# Altium schematic sheet 0223_GPU POWER_ OTHER.SchDoc
size 848 x 558 mm
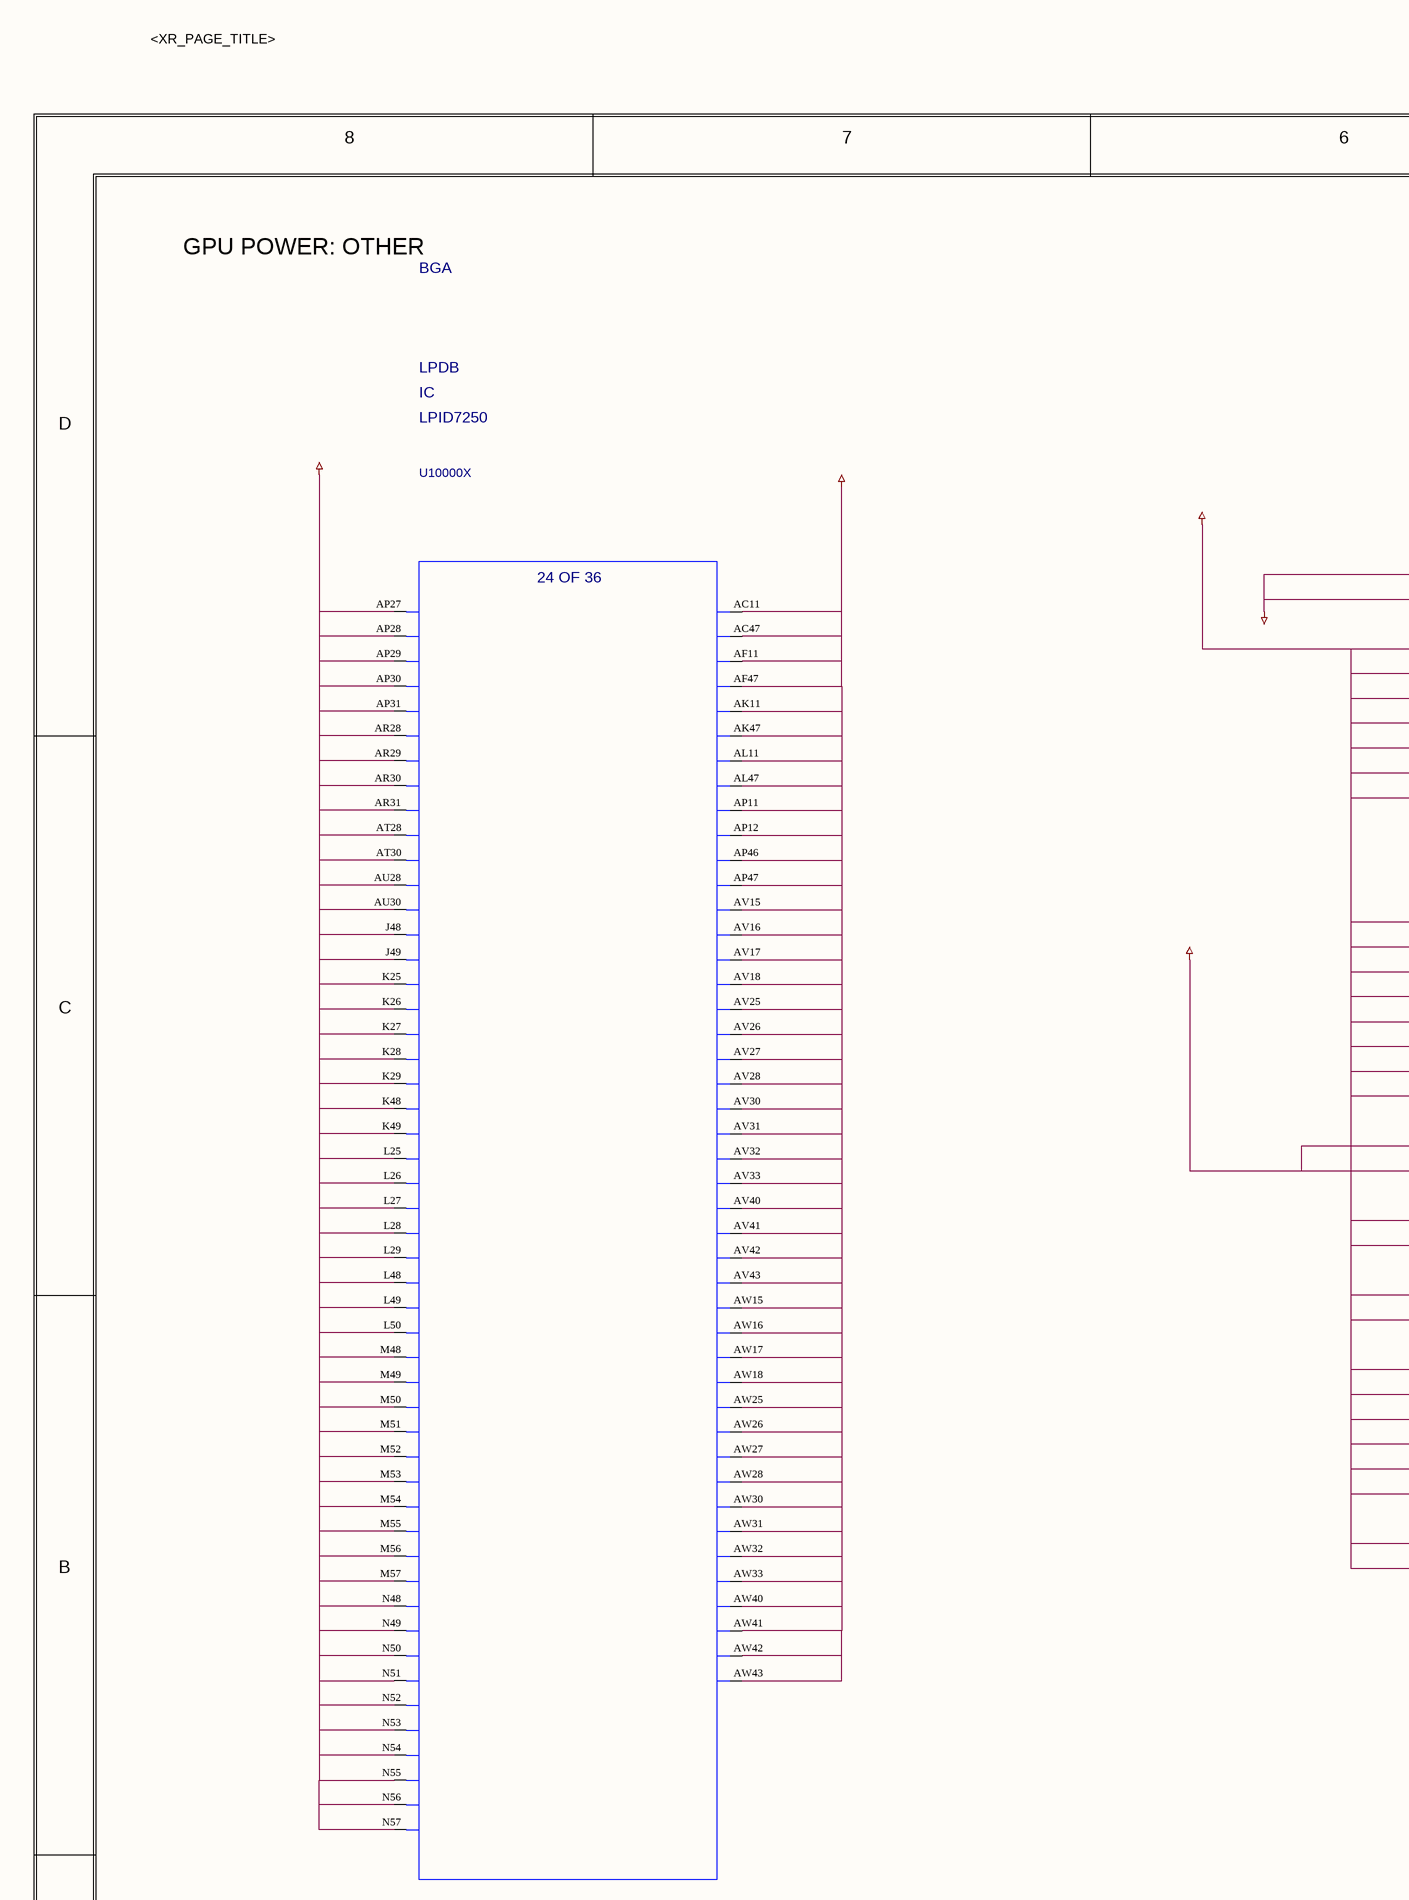
[diagram p0: 0223_GPU POWER_ OTHER.SchDoc, top left]
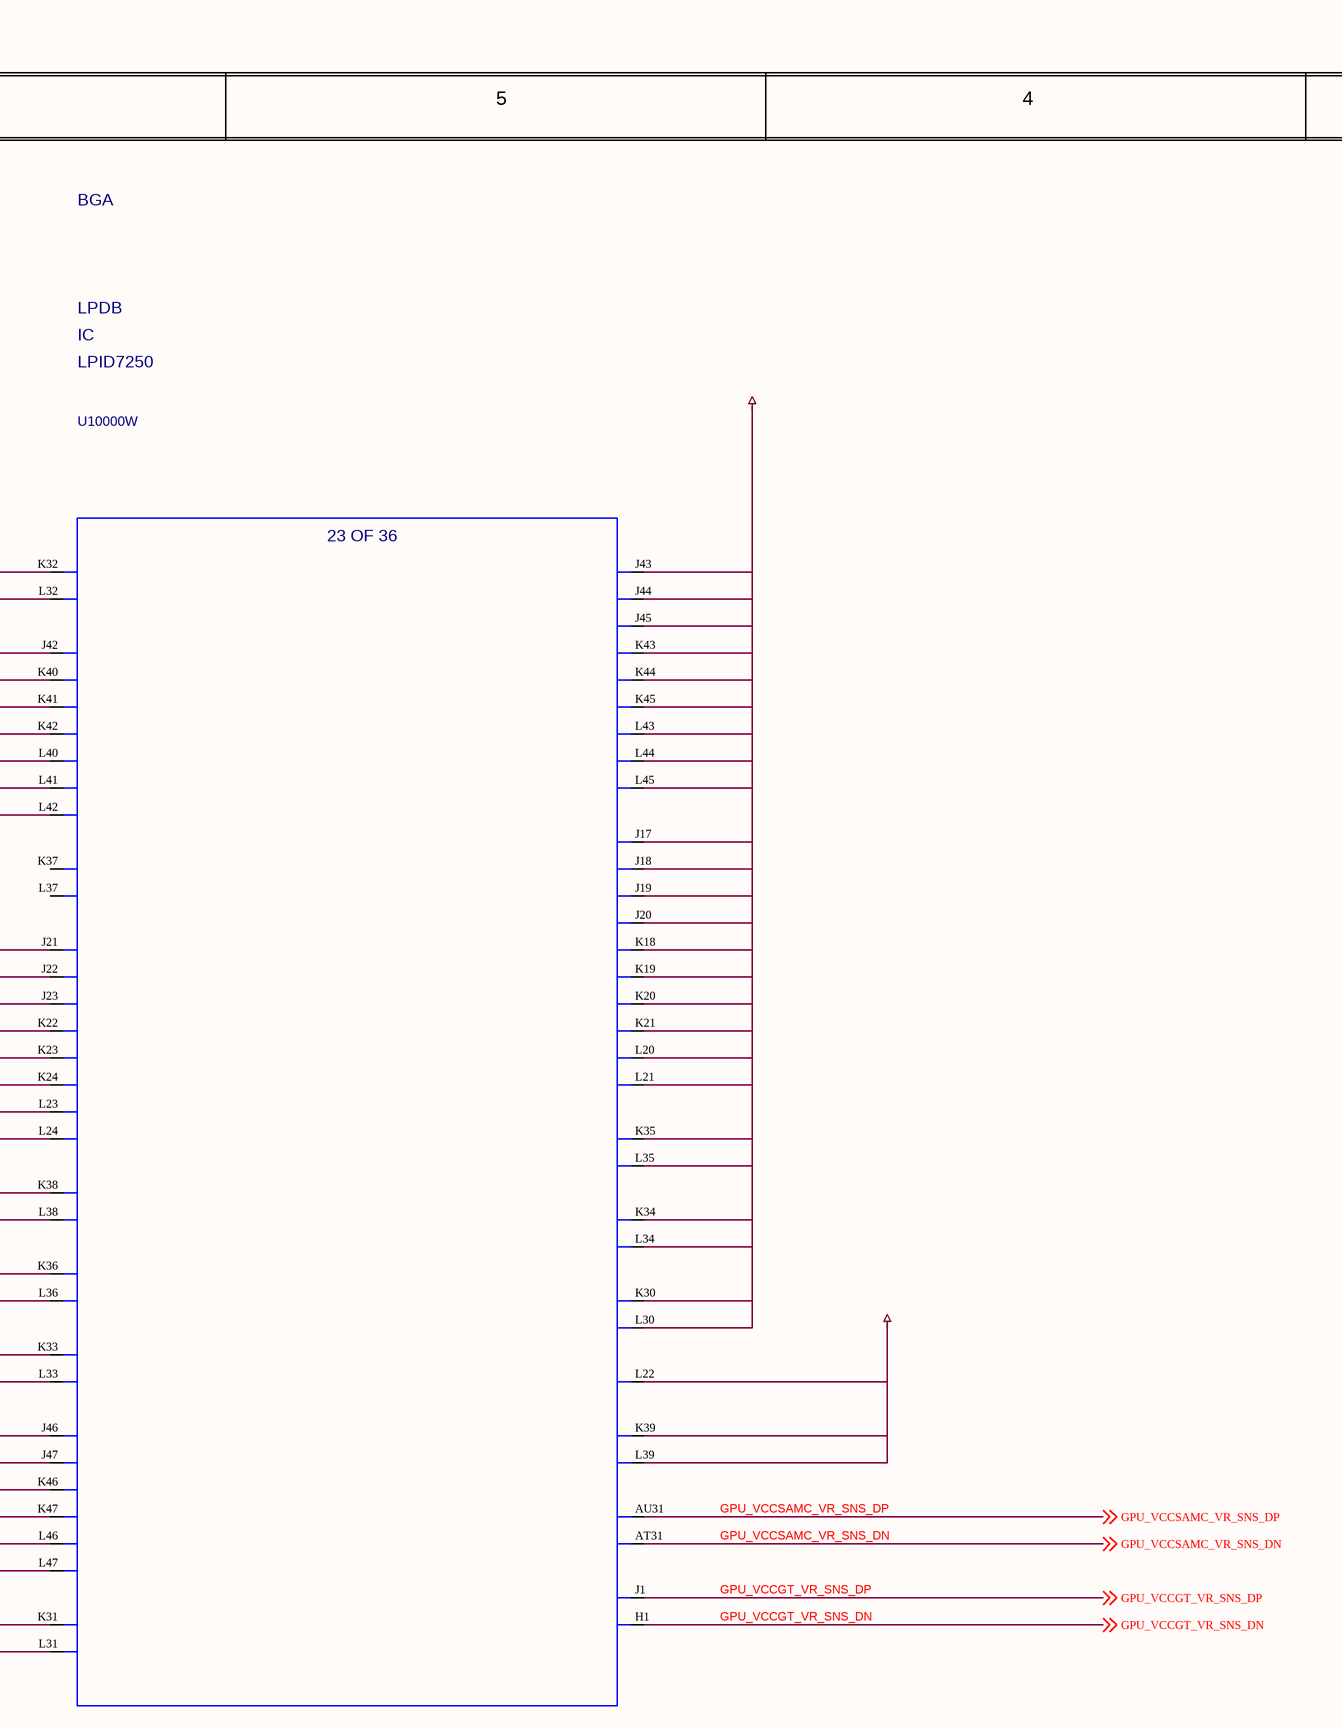
[diagram p1: 0223_GPU POWER_ OTHER.SchDoc, top middle]
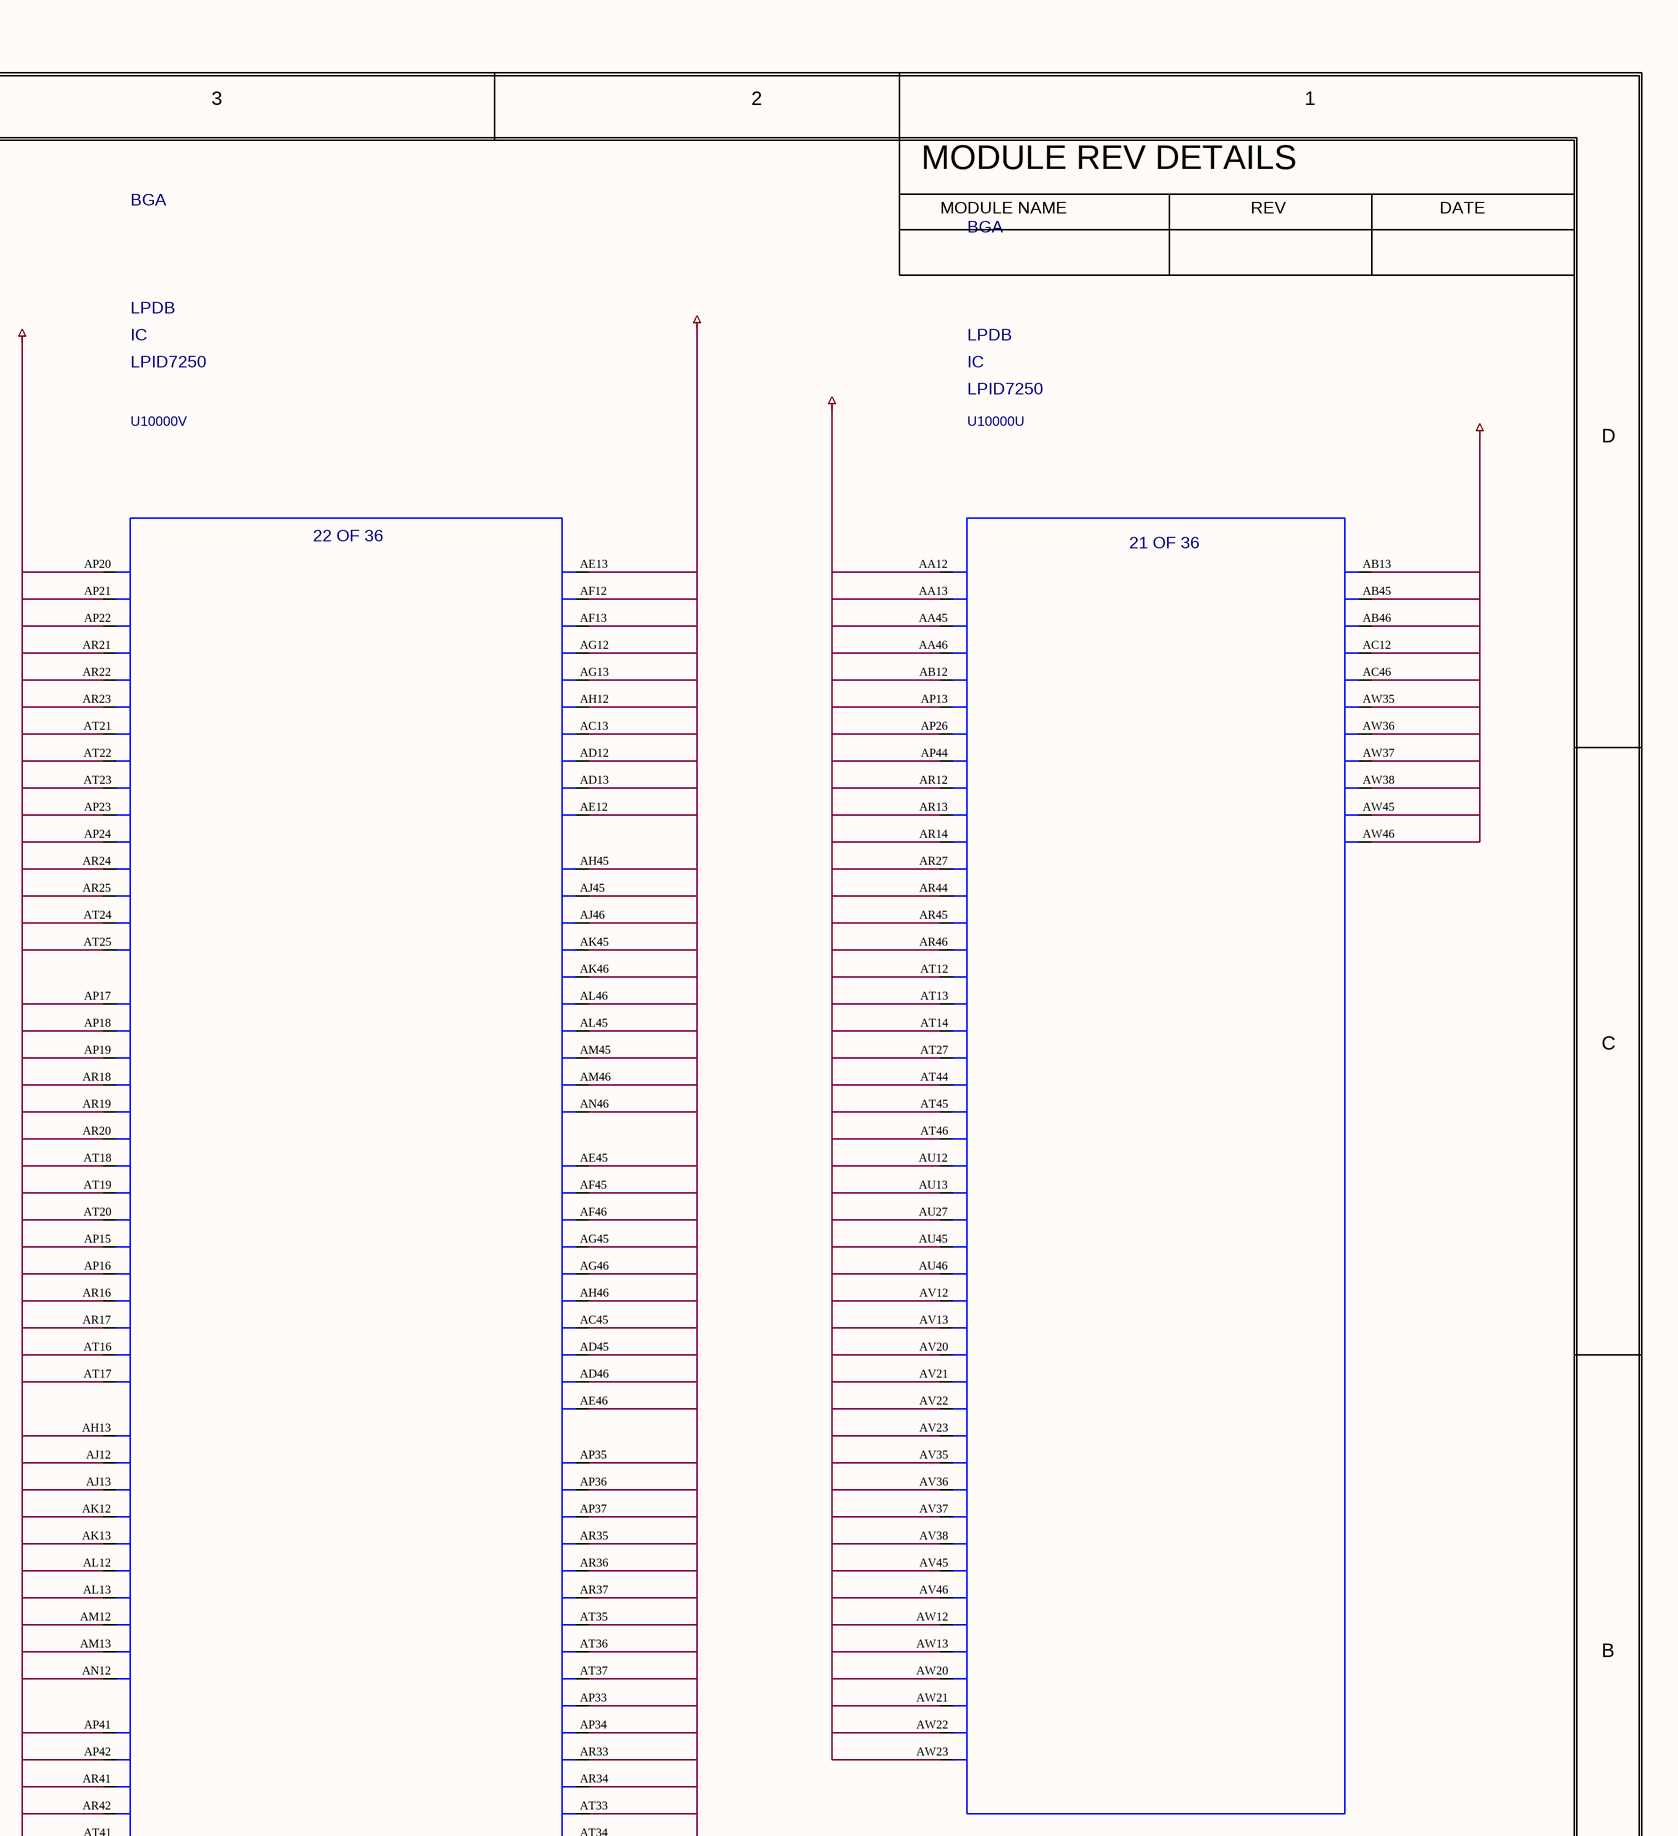
[diagram p2: 0223_GPU POWER_ OTHER.SchDoc, top right]
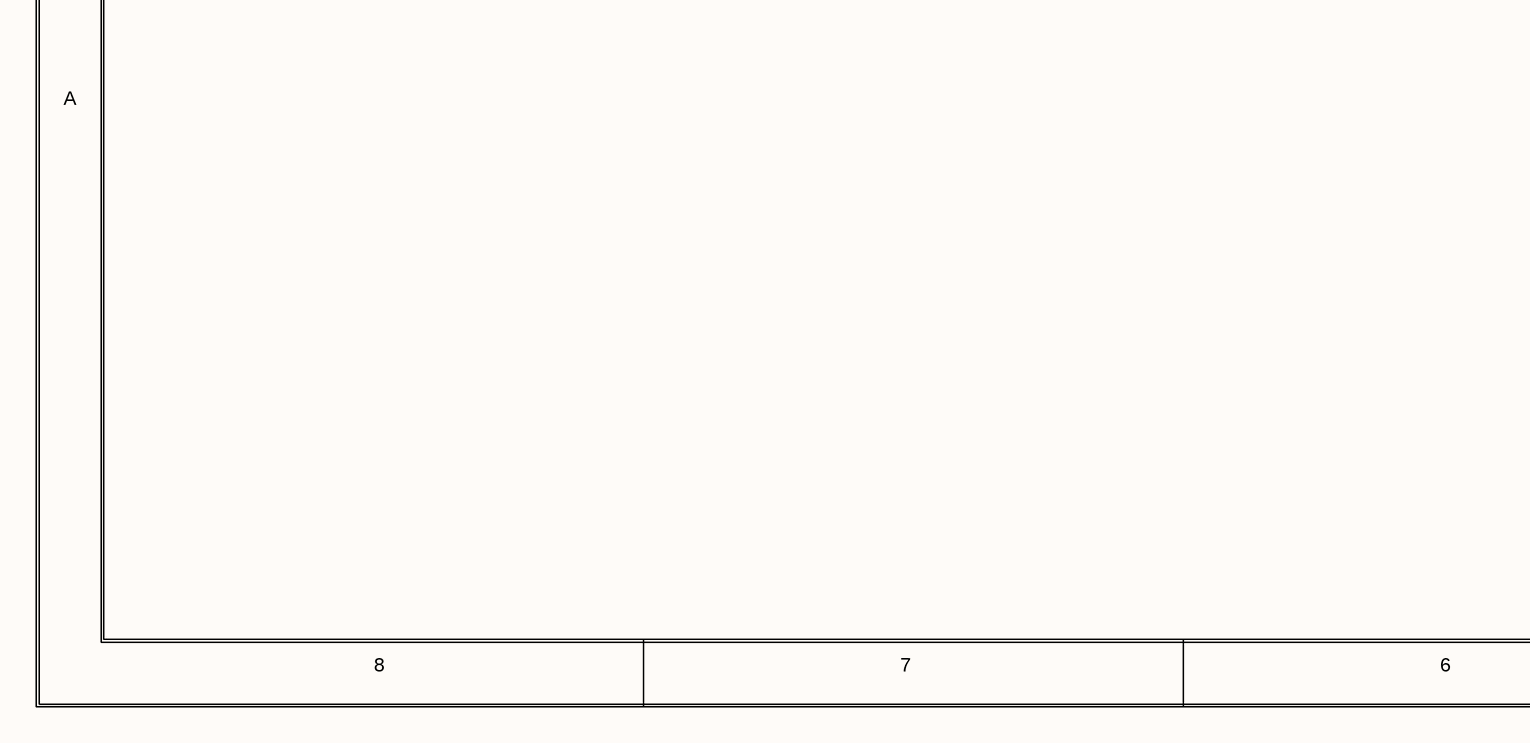
[diagram p3: 0223_GPU POWER_ OTHER.SchDoc, bottom left]
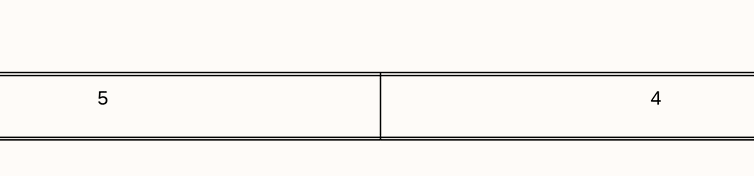
[diagram p4: 0223_GPU POWER_ OTHER.SchDoc, bottom middle]
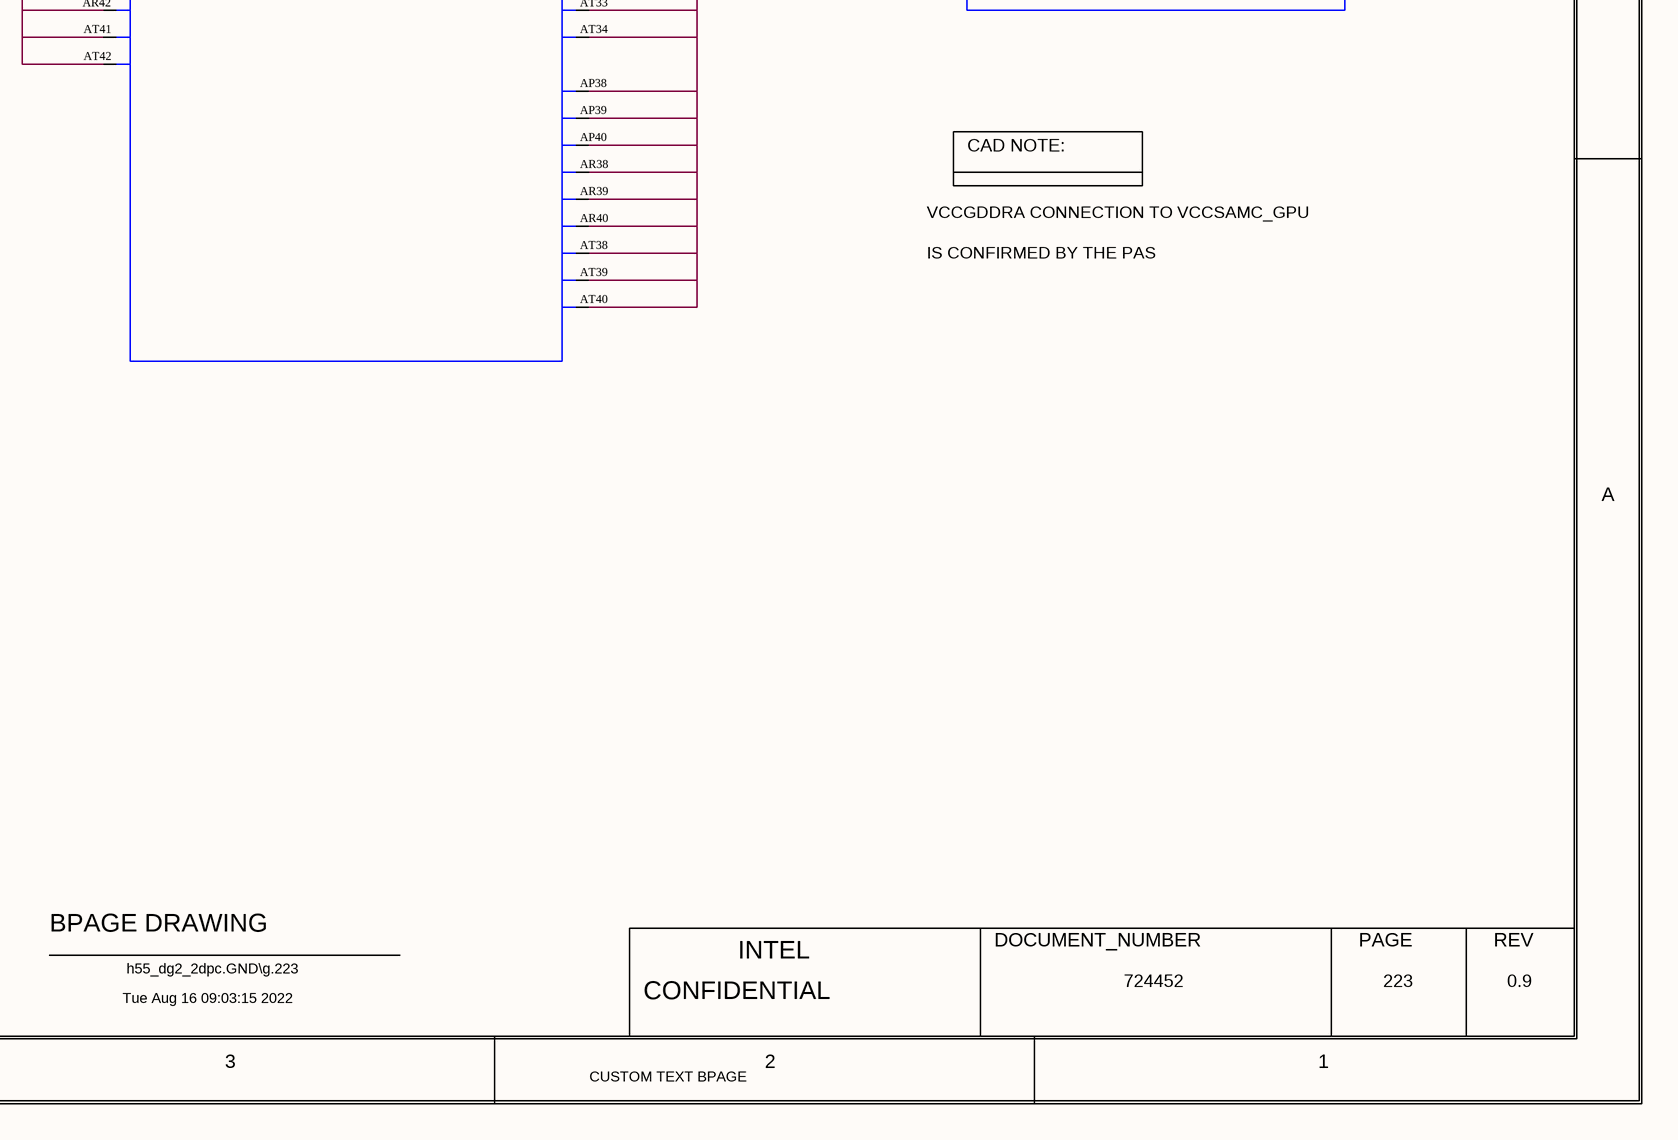
[diagram p5: 0223_GPU POWER_ OTHER.SchDoc, bottom right]

## Parts
U10000  PART_NUMBER: LPID7250  PACK_TYPE: BGA  MATERIAL: IC  FP_TECH: LPDB  [CLPDB_BGA2660_DG2_SVC_512_LP7250_MA]  (hidden comment: DG2_IP_NB_SKU1_SKU2_SKU3_EXT)  (parts U,V,W,X of 36)

## Nets
+V1P8_PLLVPH: U10000.K38(VCCPLLVPH_1) U10000.L38(VCCPLLVPH_2)
+V1P8S_GPU: U10000.J21(VCC1P8_14) U10000.J22(VCC1P8_15) U10000.J23(VCC1P8_16) U10000.J42(VCC1P8_1) U10000.J46(VCC1P8_8) U10000.J47(VCC1P8_9) U10000.K22(VCC1P8_17) U10000.K23(VCC1P8_18) U10000.K24(VCC1P8_19) U10000.K31(VCC1P8_27) U10000.K33(VCC1P8_29) U10000.K36(VCC1P8_22) U10000.K39(VCC1P8_25) U10000.K40(VCC1P8_2) U10000.K41(VCC1P8_3) U10000.K42(VCC1P8_4) U10000.K46(VCC1P8_10) U10000.K47(VCC1P8_11) U10000.L22(VCC1P8_24) U10000.L23(VCC1P8_20) U10000.L24(VCC1P8_21) U10000.L31(VCC1P8_28) U10000.L33(VCC1P8_30) U10000.L36(VCC1P8_23) U10000.L39(VCC1P8_26) U10000.L40(VCC1P8_5) U10000.L41(VCC1P8_6) U10000.L42(VCC1P8_7) U10000.L46(VCC1P8_12) U10000.L47(VCC1P8_13)
+VCCSA_GPU: U10000.AP27(VCCSA_1) U10000.AP28(VCCSA_2) U10000.AP29(VCCSA_3) U10000.AP30(VCCSA_4) U10000.AP31(VCCSA_5) U10000.AR28(VCCSA_6) U10000.AR29(VCCSA_7) U10000.AR30(VCCSA_8) U10000.AR31(VCCSA_9) U10000.AT28(VCCSA_10) U10000.AT30(VCCSA_11) U10000.AU28(VCCSA_12) U10000.AU30(VCCSA_13) U10000.J17(VCCSA_61) U10000.J18(VCCSA_62) U10000.J19(VCCSA_63) U10000.J20(VCCSA_64) U10000.J43(VCCSA_52) U10000.J44(VCCSA_53) U10000.J45(VCCSA_54) U10000.J48(VCCSA_14) U10000.J49(VCCSA_15) U10000.K18(VCCSA_65) U10000.K19(VCCSA_66) U10000.K20(VCCSA_67) U10000.K21(VCCSA_68) U10000.K25(VCCSA_16) U10000.K26(VCCSA_17) U10000.K27(VCCSA_18) U10000.K28(VCCSA_19) U10000.K29(VCCSA_20) U10000.K30(VCCSA_73) U10000.K34(VCCSA_75) U10000.K35(VCCSA_71) U10000.K43(VCCSA_55) U10000.K44(VCCSA_56) U10000.K45(VCCSA_57) U10000.K48(VCCSA_21) U10000.K49(VCCSA_22) U10000.L20(VCCSA_69) U10000.L21(VCCSA_70) U10000.L25(VCCSA_23) U10000.L26(VCCSA_24) U10000.L27(VCCSA_25) U10000.L28(VCCSA_26) U10000.L29(VCCSA_27) U10000.L30(VCCSA_74) U10000.L34(VCCSA_76) U10000.L35(VCCSA_72) U10000.L43(VCCSA_58) U10000.L44(VCCSA_59) U10000.L45(VCCSA_60) U10000.L48(VCCSA_28) U10000.L49(VCCSA_29) U10000.L50(VCCSA_30) U10000.M48(VCCSA_31) U10000.M49(VCCSA_32) U10000.M50(VCCSA_33) U10000.M51(VCCSA_34) U10000.M52(VCCSA_35) U10000.M53(VCCSA_36) U10000.M54(VCCSA_37) U10000.M55(VCCSA_38) U10000.M56(VCCSA_39) U10000.M57(VCCSA_40) U10000.N48(VCCSA_41) U10000.N49(VCCSA_42) U10000.N50(VCCSA_43) U10000.N51(VCCSA_44) U10000.N52(VCCSA_45) U10000.N53(VCCSA_46) U10000.N54(VCCSA_47) U10000.N55(VCCSA_48) U10000.N56(VCCSA_49) U10000.N57(VCCSA_50)
+VCCSAMC_GPU: U10000.AA12(VCCGDDRA_1) U10000.AA13(VCCGDDRA_2) U10000.AA45(VCCGDDRA_3) U10000.AA46(VCCGDDRA_4) U10000.AB12(VCCGDDRA_5) U10000.AB13(VCCGDDRA_6) U10000.AB45(VCCGDDRA_7) U10000.AB46(VCCGDDRA_8) U10000.AC11(VCCSAMC_1) U10000.AC12(VCCGDDRA_9) U10000.AC46(VCCGDDRA_10) U10000.AC47(VCCSAMC_2) U10000.AF11(VCCSAMC_3) U10000.AF47(VCCSAMC_4) U10000.AK11(VCCSAMC_5) U10000.AK47(VCCSAMC_6) U10000.AL11(VCCSAMC_7) U10000.AL47(VCCSAMC_8) U10000.AP11(VCCSAMC_9) U10000.AP12(VCCSAMC_10) U10000.AP13(VCCGDDRA_11) U10000.AP26(VCCGDDRA_12) U10000.AP44(VCCGDDRA_13) U10000.AP46(VCCSAMC_11) U10000.AP47(VCCSAMC_12) U10000.AR12(VCCGDDRA_14) U10000.AR13(VCCGDDRA_15) U10000.AR14(VCCGDDRA_16) U10000.AR27(VCCGDDRA_17) U10000.AR44(VCCGDDRA_18) U10000.AR45(VCCGDDRA_19) U10000.AR46(VCCGDDRA_20) U10000.AT12(VCCGDDRA_21) U10000.AT13(VCCGDDRA_22) U10000.AT14(VCCGDDRA_23) U10000.AT27(VCCGDDRA_24) U10000.AT44(VCCGDDRA_25) U10000.AT45(VCCGDDRA_26) U10000.AT46(VCCGDDRA_27) U10000.AU12(VCCGDDRA_28) U10000.AU13(VCCGDDRA_29) U10000.AU27(VCCGDDRA_30) U10000.AU45(VCCGDDRA_31) U10000.AU46(VCCGDDRA_32) U10000.AV12(VCCGDDRA_33) U10000.AV13(VCCGDDRA_34) U10000.AV15(VCCSAMC_13) U10000.AV16(VCCSAMC_14) U10000.AV17(VCCSAMC_15) U10000.AV18(VCCSAMC_16) U10000.AV20(VCCGDDRA_35) U10000.AV21(VCCGDDRA_36) U10000.AV22(VCCGDDRA_37) U10000.AV23(VCCGDDRA_38) U10000.AV25(VCCSAMC_17) U10000.AV26(VCCSAMC_18) U10000.AV27(VCCSAMC_19) U10000.AV28(VCCSAMC_20) U10000.AV30(VCCSAMC_21) U10000.AV31(VCCSAMC_22) U10000.AV32(VCCSAMC_23) U10000.AV33(VCCSAMC_24) U10000.AV35(VCCGDDRA_39) U10000.AV36(VCCGDDRA_40) U10000.AV37(VCCGDDRA_41) U10000.AV38(VCCGDDRA_42) U10000.AV40(VCCSAMC_25) U10000.AV41(VCCSAMC_26) U10000.AV42(VCCSAMC_27) U10000.AV43(VCCSAMC_28) U10000.AV45(VCCGDDRA_43) U10000.AV46(VCCGDDRA_44) U10000.AW12(VCCGDDRA_45) U10000.AW13(VCCGDDRA_46) U10000.AW15(VCCSAMC_29) U10000.AW16(VCCSAMC_30) U10000.AW17(VCCSAMC_31) U10000.AW18(VCCSAMC_32) U10000.AW20(VCCGDDRA_47) U10000.AW21(VCCGDDRA_48) U10000.AW22(VCCGDDRA_49) U10000.AW23(VCCGDDRA_50) U10000.AW25(VCCSAMC_33) U10000.AW26(VCCSAMC_34) U10000.AW27(VCCSAMC_35) U10000.AW28(VCCSAMC_36) U10000.AW30(VCCSAMC_37) U10000.AW31(VCCSAMC_38) U10000.AW32(VCCSAMC_39) U10000.AW33(VCCSAMC_40) U10000.AW35(VCCGDDRA_51) U10000.AW36(VCCGDDRA_52) U10000.AW37(VCCGDDRA_53) U10000.AW38(VCCGDDRA_54) U10000.AW40(VCCSAMC_41) U10000.AW41(VCCSAMC_42) U10000.AW42(VCCSAMC_43) U10000.AW43(VCCSAMC_44) U10000.AW45(VCCGDDRA_55) U10000.AW46(VCCGDDRA_56)
+VDDQ_GPU: U10000.AC13(VCCGDDRP4_1) U10000.AC45(VCCGDDRP2_1) U10000.AD12(VCCGDDRP4_2) U10000.AD13(VCCGDDRP4_3) U10000.AD45(VCCGDDRP2_2) U10000.AD46(VCCGDDRP2_3) U10000.AE12(VCCGDDRP4_4) U10000.AE13(VCCGDDRIO4_1) U10000.AE45(VCCGDDRIO2_1) U10000.AE46(VCCGDDRP2_4) U10000.AF12(VCCGDDRIO4_2) U10000.AF13(VCCGDDRIO4_3) U10000.AF45(VCCGDDRIO2_2) U10000.AF46(VCCGDDRIO2_3) U10000.AG12(VCCGDDRIO4_4) U10000.AG13(VCCGDDRIO4_5) U10000.AG45(VCCGDDRIO2_4) U10000.AG46(VCCGDDRIO2_5) U10000.AH12(VCCGDDRIO4_6) U10000.AH13(VCCGDDRIO5_1) U10000.AH45(VCCGDDRIO3_1) U10000.AH46(VCCGDDRIO2_6) U10000.AJ12(VCCGDDRIO5_2) U10000.AJ13(VCCGDDRIO5_3) U10000.AJ45(VCCGDDRIO3_2) U10000.AJ46(VCCGDDRIO3_3) U10000.AK12(VCCGDDRIO5_4) U10000.AK13(VCCGDDRIO5_5) U10000.AK45(VCCGDDRIO3_4) U10000.AK46(VCCGDDRIO3_5) U10000.AL12(VCCGDDRIO5_6) U10000.AL13(VCCGDDRP5_1) U10000.AL45(VCCGDDRP3_1) U10000.AL46(VCCGDDRIO3_6) U10000.AM12(VCCGDDRP5_2) U10000.AM13(VCCGDDRP5_3) U10000.AM45(VCCGDDRP3_2) U10000.AM46(VCCGDDRP3_3) U10000.AN12(VCCGDDRP5_4) U10000.AN46(VCCGDDRP3_4) U10000.AP15(VCCGDDRP6_1) U10000.AP16(VCCGDDRP6_2) U10000.AP17(VCCGDDRIO6_1) U10000.AP18(VCCGDDRIO6_2) U10000.AP19(VCCGDDRIO6_3) U10000.AP20(VCCGDDRIO7_1) U10000.AP21(VCCGDDRIO7_2) U10000.AP22(VCCGDDRIO7_3) U10000.AP23(VCCGDDRP7_1) U10000.AP24(VCCGDDRP7_2) U10000.AP33(VCCGDDRP1_1) U10000.AP34(VCCGDDRP1_2) U10000.AP35(VCCGDDRIO1_1) U10000.AP36(VCCGDDRIO1_2) U10000.AP37(VCCGDDRIO1_3) U10000.AP38(VCCGDDRIO0_1) U10000.AP39(VCCGDDRIO0_2) U10000.AP40(VCCGDDRIO0_3) U10000.AP41(VCCGDDRP0_1) U10000.AP42(VCCGDDRP0_2) U10000.AR16(VCCGDDRP6_3) U10000.AR17(VCCGDDRP6_4) U10000.AR18(VCCGDDRIO6_4) U10000.AR19(VCCGDDRIO6_5) U10000.AR20(VCCGDDRIO6_6) U10000.AR21(VCCGDDRIO7_4) U10000.AR22(VCCGDDRIO7_5) U10000.AR23(VCCGDDRIO7_6) U10000.AR24(VCCGDDRP7_3) U10000.AR25(VCCGDDRP7_4) U10000.AR33(VCCGDDRP1_3) U10000.AR34(VCCGDDRP1_4) U10000.AR35(VCCGDDRIO1_4) U10000.AR36(VCCGDDRIO1_5) U10000.AR37(VCCGDDRIO1_6) U10000.AR38(VCCGDDRIO0_4) U10000.AR39(VCCGDDRIO0_5) U10000.AR40(VCCGDDRIO0_6) U10000.AR41(VCCGDDRP0_3) U10000.AR42(VCCGDDRP0_4) U10000.AT16(VCCGDDRP6_5) U10000.AT17(VCCGDDRP6_6) U10000.AT18(VCCGDDRIO6_7) U10000.AT19(VCCGDDRIO6_8) U10000.AT20(VCCGDDRIO6_9) U10000.AT21(VCCGDDRIO7_7) U10000.AT22(VCCGDDRIO7_8) U10000.AT23(VCCGDDRIO7_9) U10000.AT24(VCCGDDRP7_5) U10000.AT25(VCCGDDRP7_6) U10000.AT33(VCCGDDRP1_5) U10000.AT34(VCCGDDRP1_6) U10000.AT35(VCCGDDRIO1_7) U10000.AT36(VCCGDDRIO1_8) U10000.AT37(VCCGDDRIO1_9) U10000.AT38(VCCGDDRIO0_7) U10000.AT39(VCCGDDRIO0_8) U10000.AT40(VCCGDDRIO0_9) U10000.AT41(VCCGDDRP0_5) U10000.AT42(VCCGDDRP0_6)
GND: U10000.K32(VSS_933) U10000.L32(VSS_934)
GPU_VCCGT_VR_SNS_DN: U10000.H1(VSS_GT_SENSE_N) ; off-sheet GPU_VCCGT_VR_SNS_DN
GPU_VCCGT_VR_SNS_DP: U10000.J1(VCC_GT_SENSE_P) ; off-sheet GPU_VCCGT_VR_SNS_DP
GPU_VCCSAMC_VR_SNS_DN: U10000.AT31(VSSSAMC_SENSE_N) ; off-sheet GPU_VCCSAMC_VR_SNS_DN
GPU_VCCSAMC_VR_SNS_DP: U10000.AU31(VCCSAMC_SENSE_P) ; off-sheet GPU_VCCSAMC_VR_SNS_DP

Not connected (* = marked no-connect by the designer): U10000 K37(RSVD_37) L37(RSVD_38)

## Notes on the sheet
- <XR_PAGE_TITLE>
- 8
- 7
- 6
- 5
- 4
- 3
- 2
- 1
- MODULE REV DETAILS
- GPU POWER: OTHER
- MODULE NAME
- REV
- DATE
- D
- C
- B
- CAD NOTE:
- VCCGDDRA CONNECTION TO VCCSAMC_GPU
- IS CONFIRMED BY THE PAS
- A
- BPAGE DRAWING
- INTEL
- DOCUMENT_NUMBER
- PAGE
- Tue Aug 16 09:03:15 2022
- h55_dg2_2dpc.GND\g.223
- CONFIDENTIAL
- 724452
- 223
- 0.9
- CUSTOM TEXT BPAGE
- (in symbol DG2_IP_NB_SKU1_SKU2_SKU3_EXT, part U) 21 OF 36
- (in symbol DG2_IP_NB_SKU1_SKU2_SKU3_EXT, part V) 22 OF 36
- (in symbol DG2_IP_NB_SKU1_SKU2_SKU3_EXT, part W) 23 OF 36
- (in symbol DG2_IP_NB_SKU1_SKU2_SKU3_EXT, part X) 24 OF 36

## Library data of the parts
U10000 = DG2_IP_NB_SKU1_SKU2_SKU3_EXT: MANUF: INTEL CORP; CDS_PHYS_PART_NAME: DG2_IP_NB_SKU1_SKU2_SKU3_EXT_BGA-LPID7250,IC,DG2_IP_NB_SKU1_SKUA; CDS_LMAN_SYM_OUTLINE: -300,850,300,-800; OriginalSymbolOrigin: (-325,850); CaptureCellPackProp: DG2_IP_NB_SKU1_SKU2_SKU3_EXTU; XY: (-2350,1750); VER: 21; ROT: 0; PHYS_PAGE: 223; MFG_PN: NONE; LOCATION: U10000; DRAWING: @RVP1_ADL_SB_ADP_S_DDR5_SODIMM_2DPC_LIB.H55_DG2_2DPC(SCH_1):PAGE394; CDS_LIB: rvp1_adl_sb_adp_s_ddr5_sodimm_2dpc_lib; BMAP_REV: 1.0; PCB Footprint: CLPDB_BGA2660_DG2_SVC_512_LP7250_MA; SEC_TYPE: BGA; CHIPS_PART_NAME: DG2_IP_NB_SKU1_SKU2_SKU3_EXT; CDS_PART_NAME: DG2_IP_NB_SKU1_SKU2_SKU3_EXT_BGA-LPID7250,IC,DG2_IP_NB_SKU1_SKUA; CDS_LOCATION: U10000